# EasyEDA Pro project BlueberryPi.eprj, schematic BlueberryPi Board, sheets 1 to 8 of 13 (continued)
## Sheets (continued)
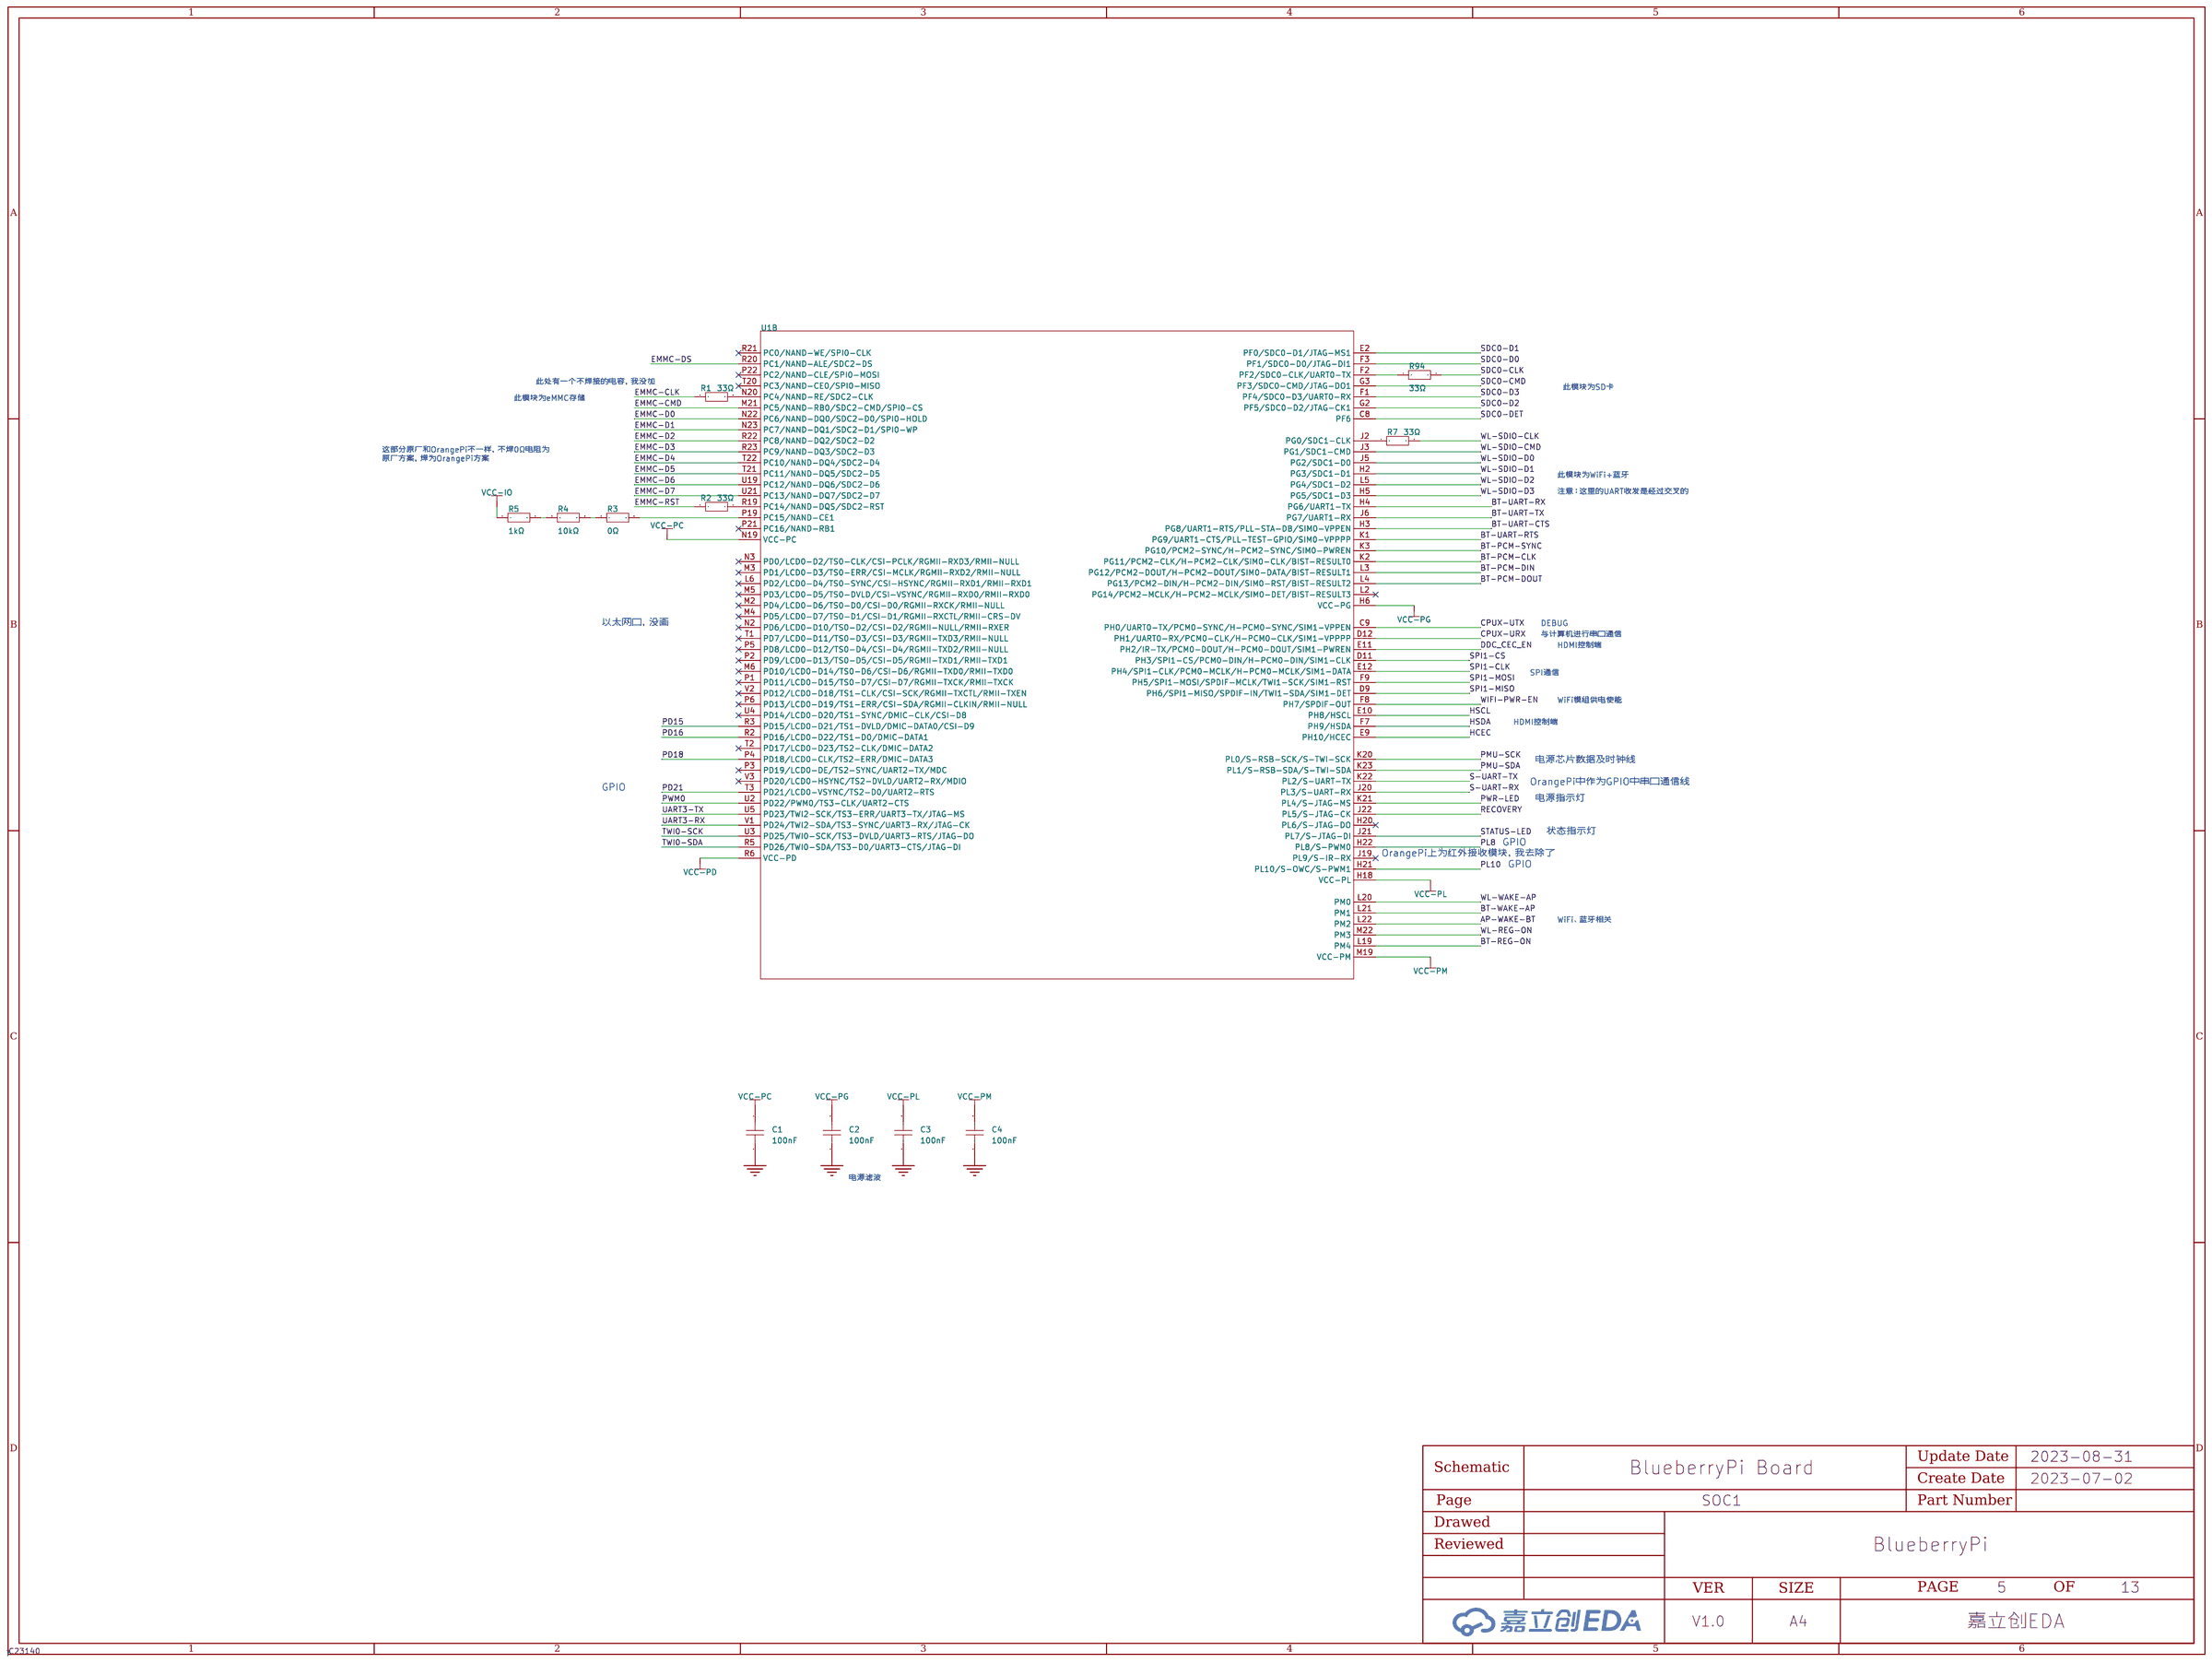
[diagram p4: SOC1]
6 SOC2: Page Name: SOC2; Update Date: 2023-09-08
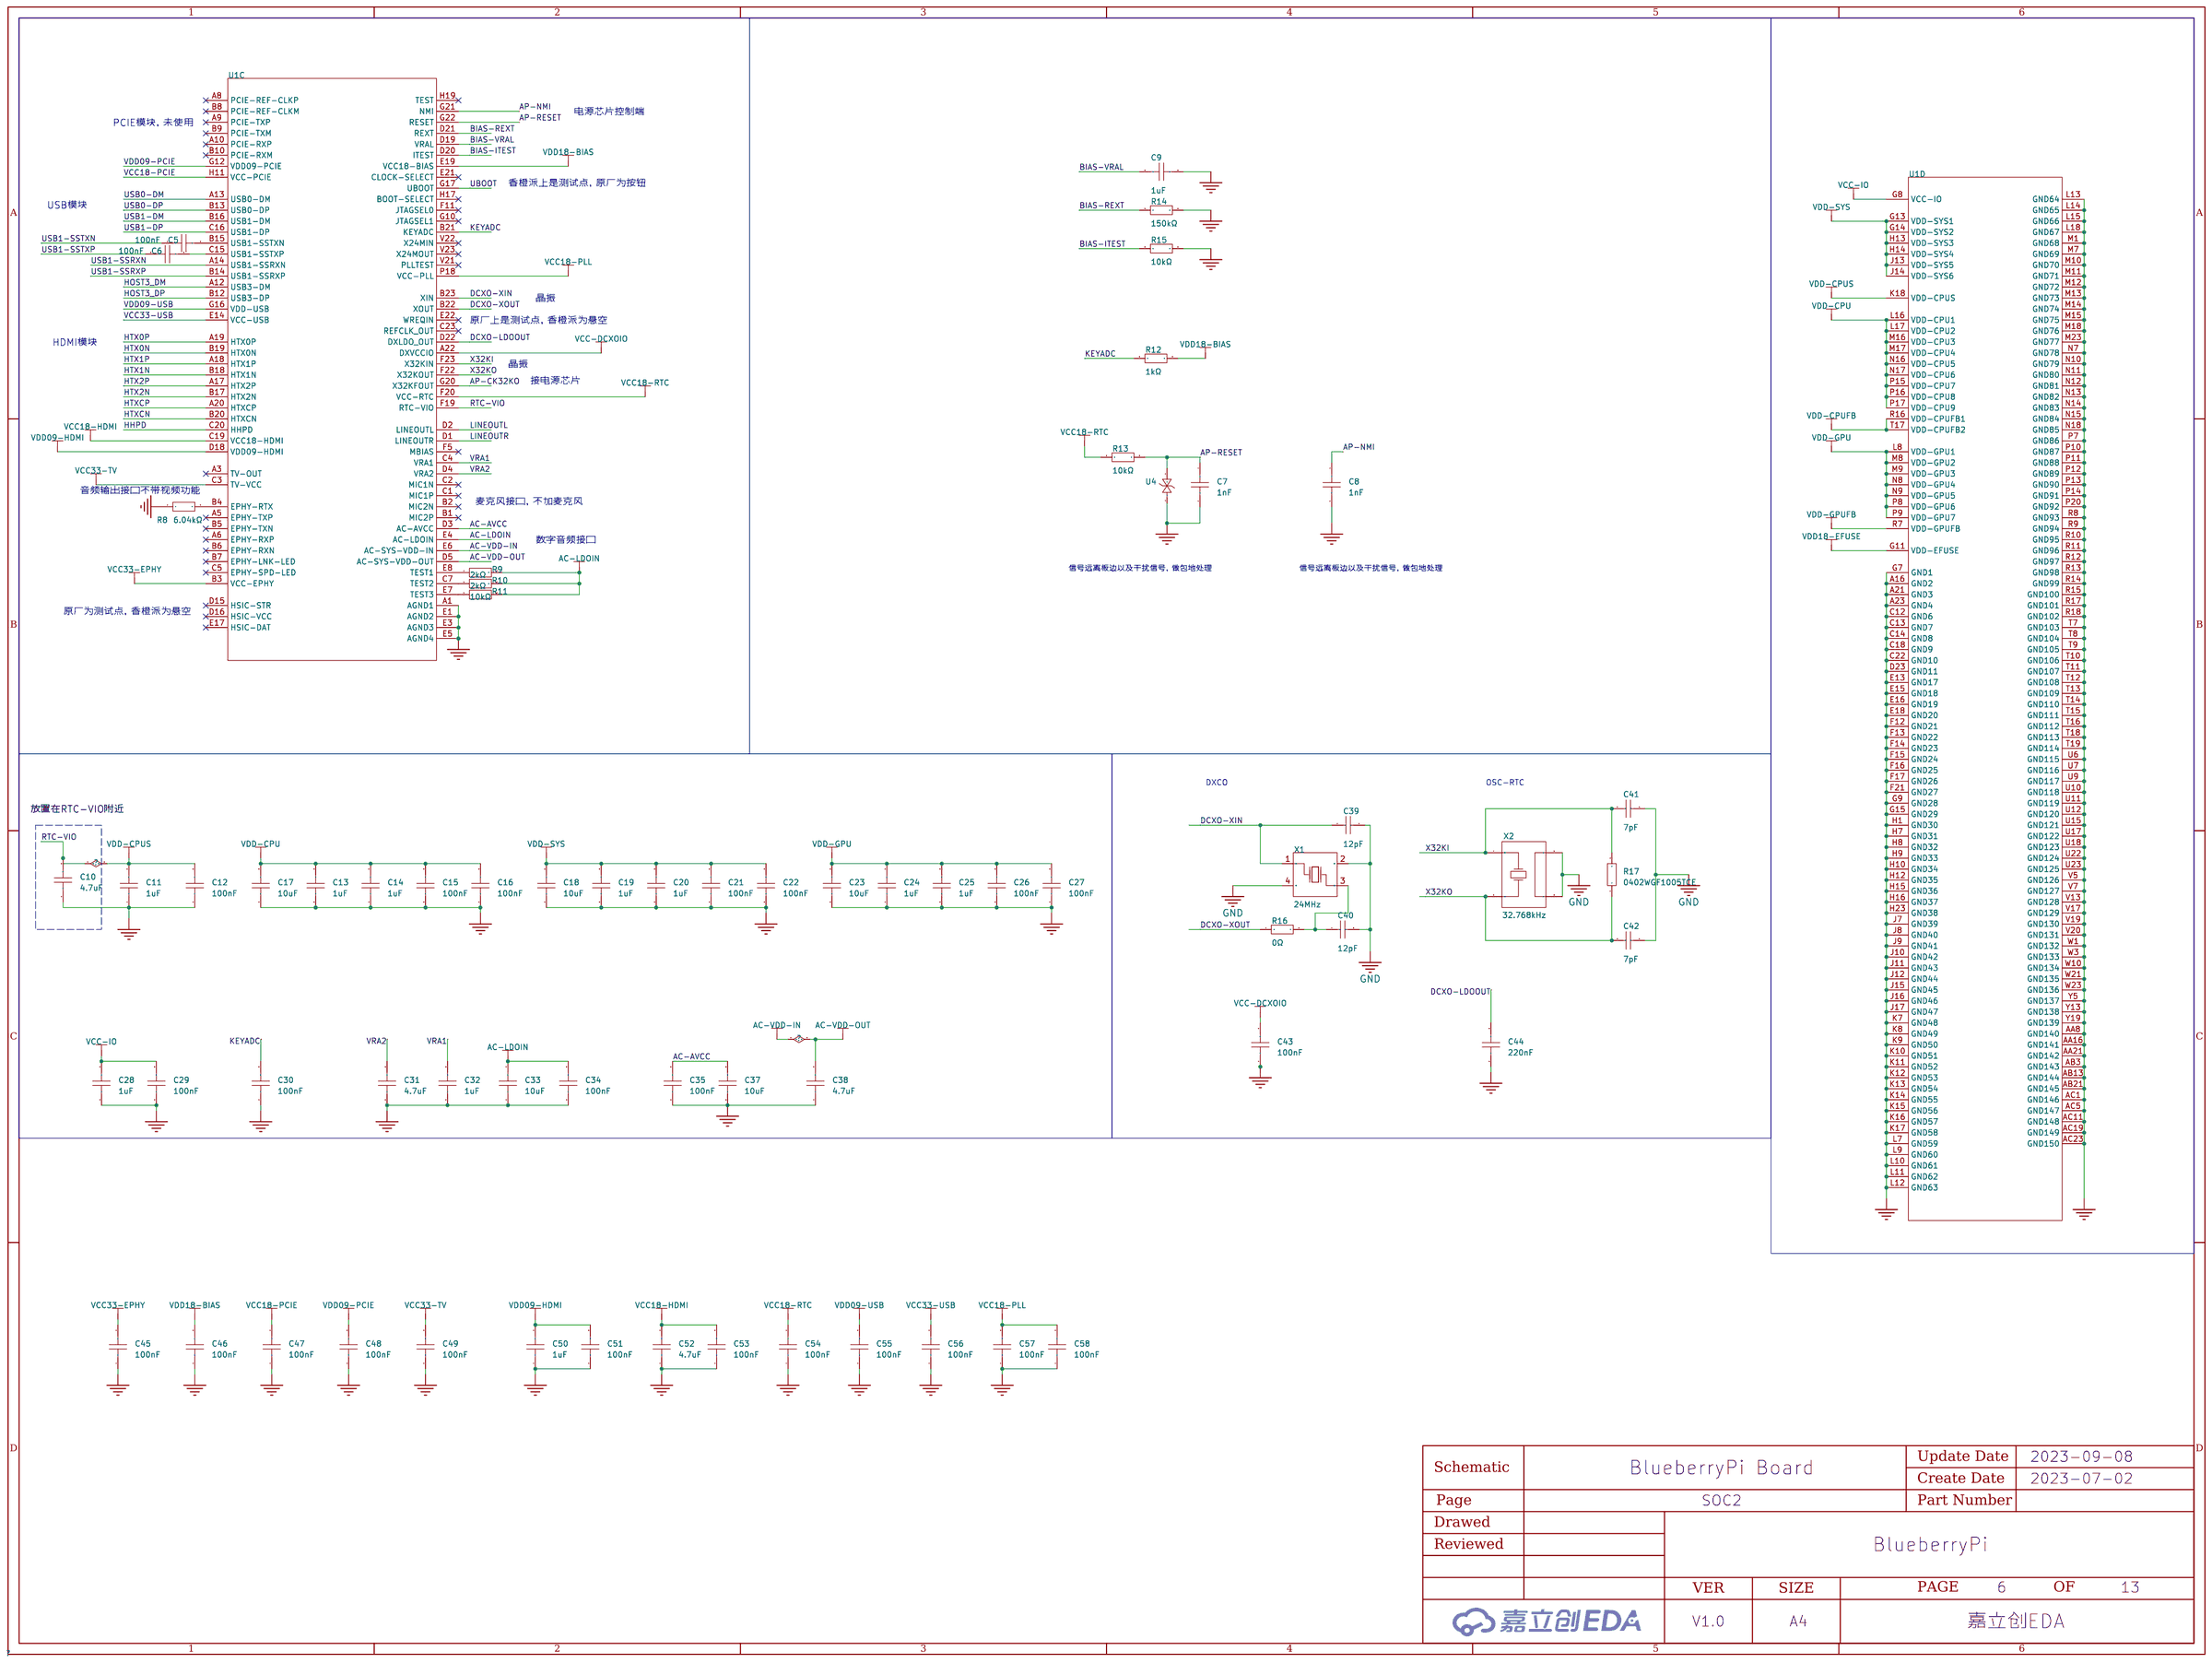
[diagram p5: SOC2]
7 LPDDR3: Page Name: LPDDR3; Update Date: 2023-08-31
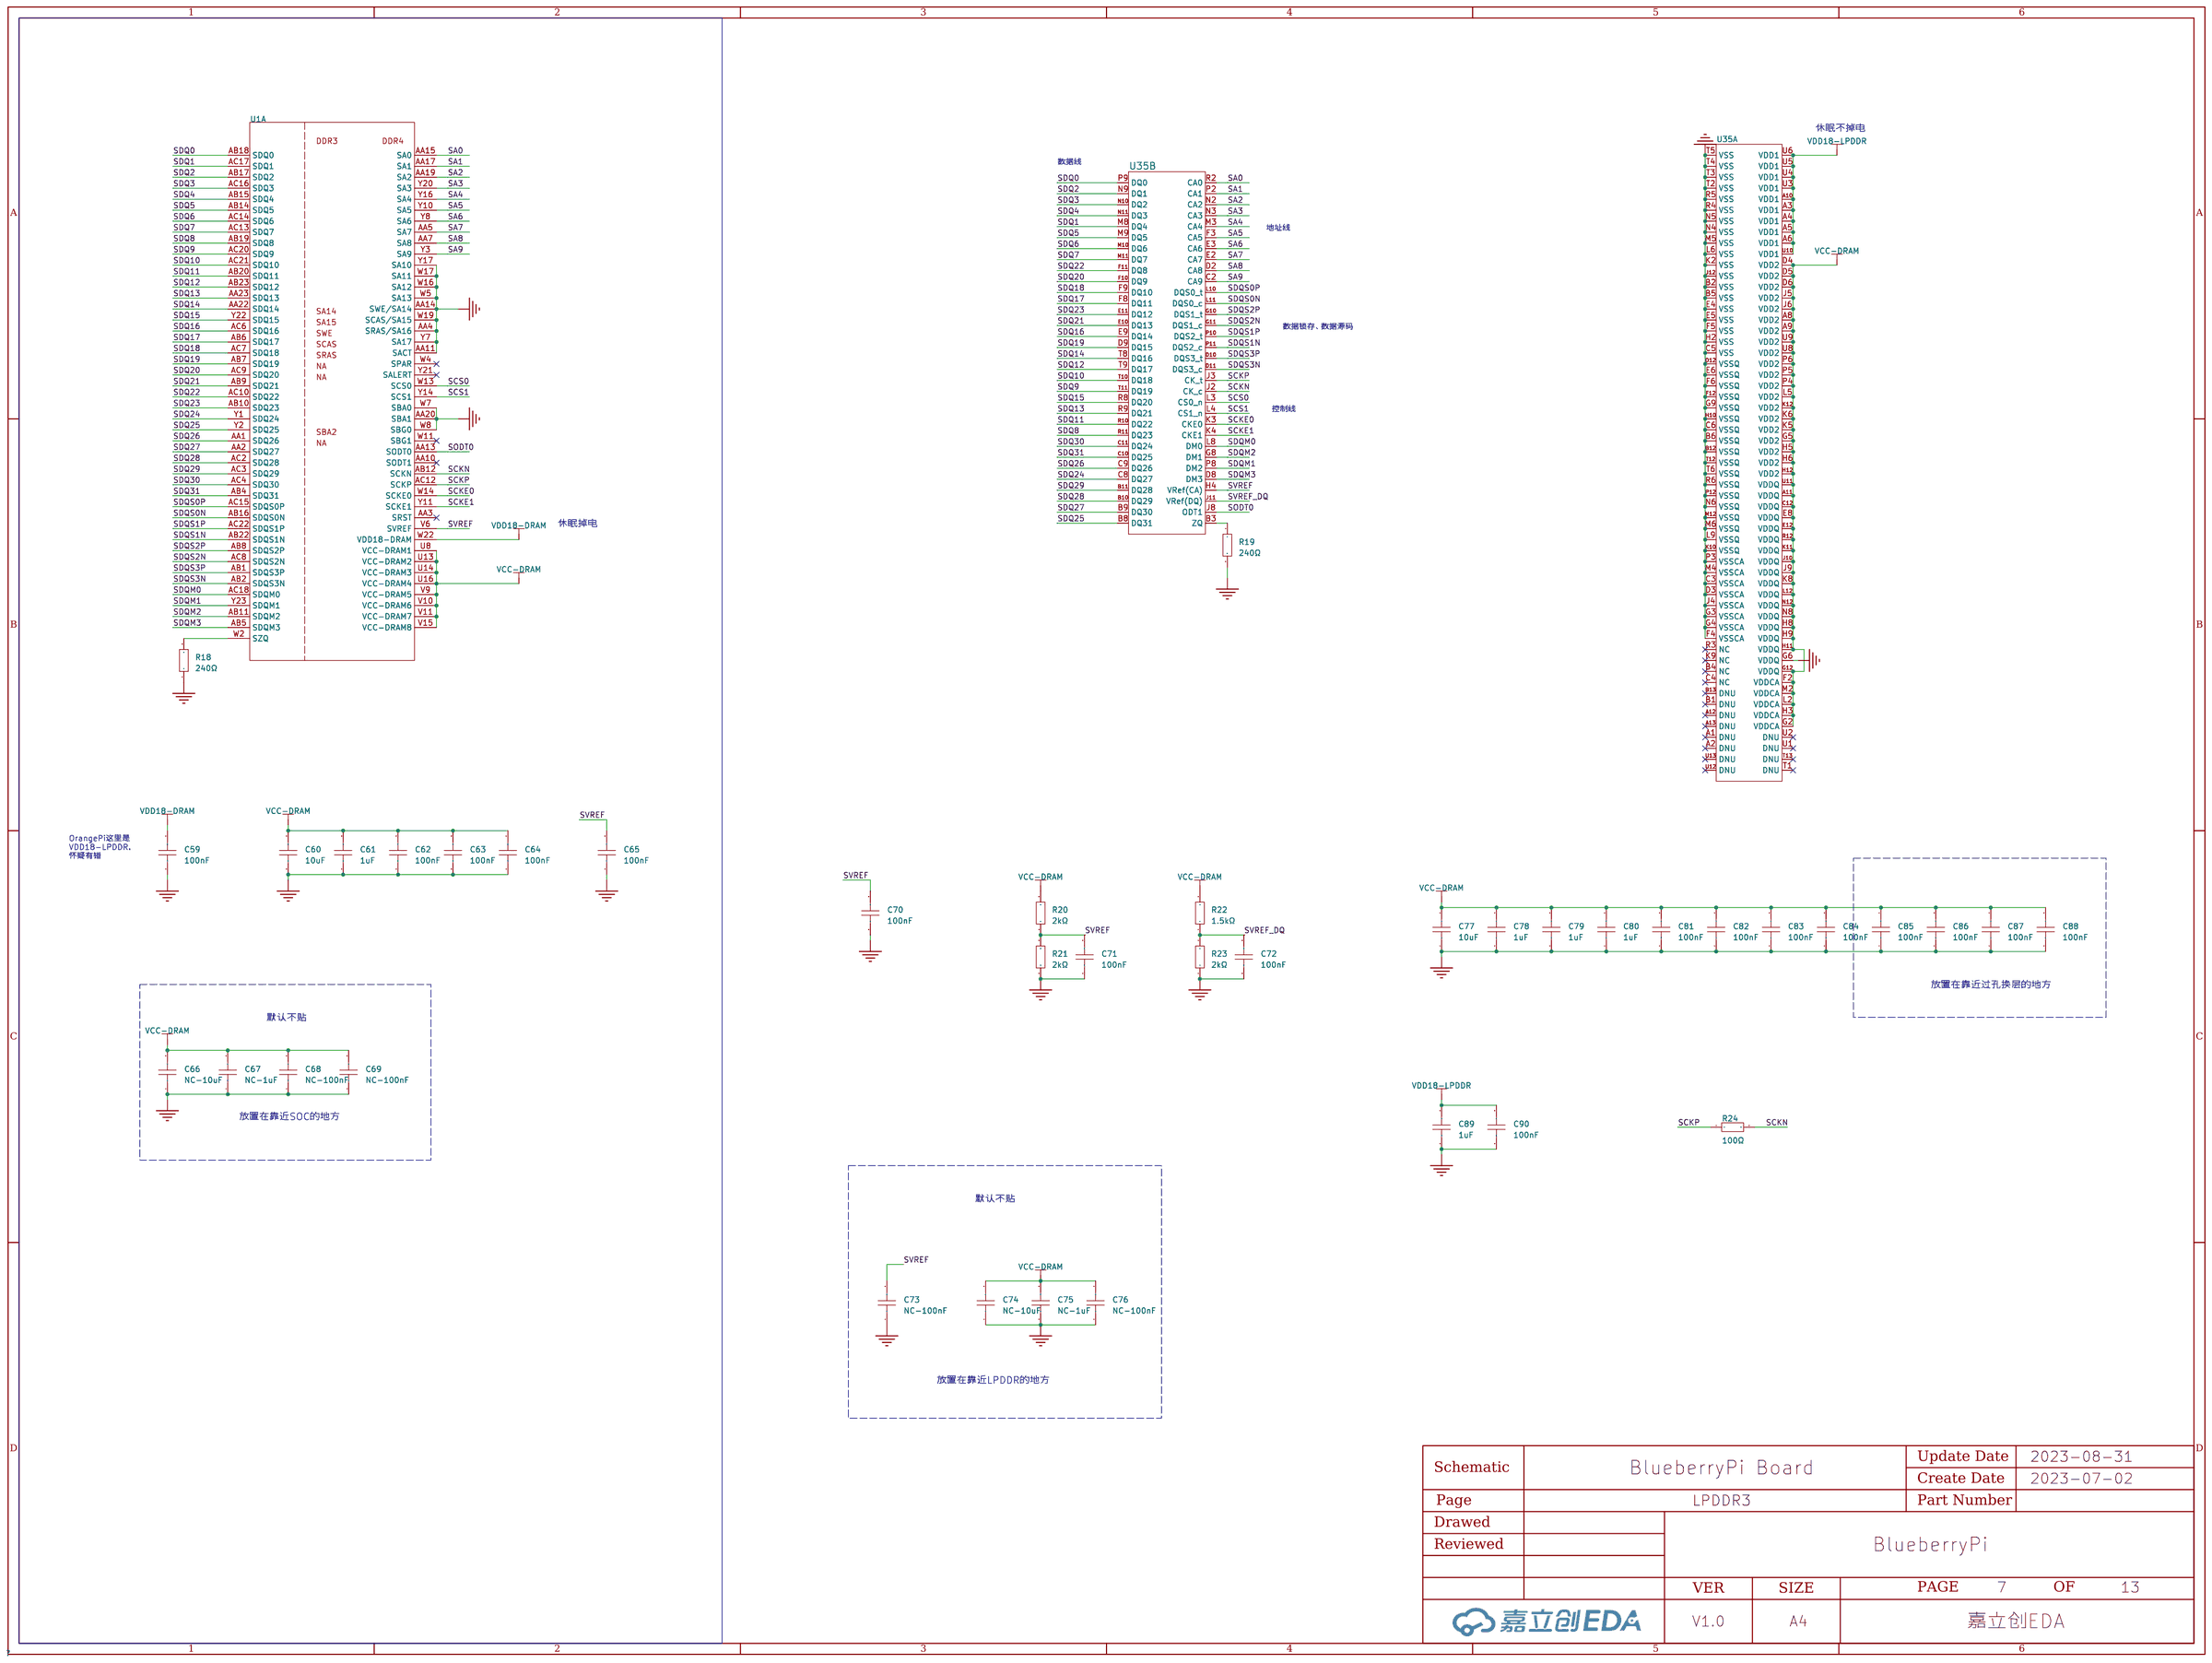
[diagram p6: LPDDR3]
8 POWER: Page Name: POWER; Update Date: 2023-09-08
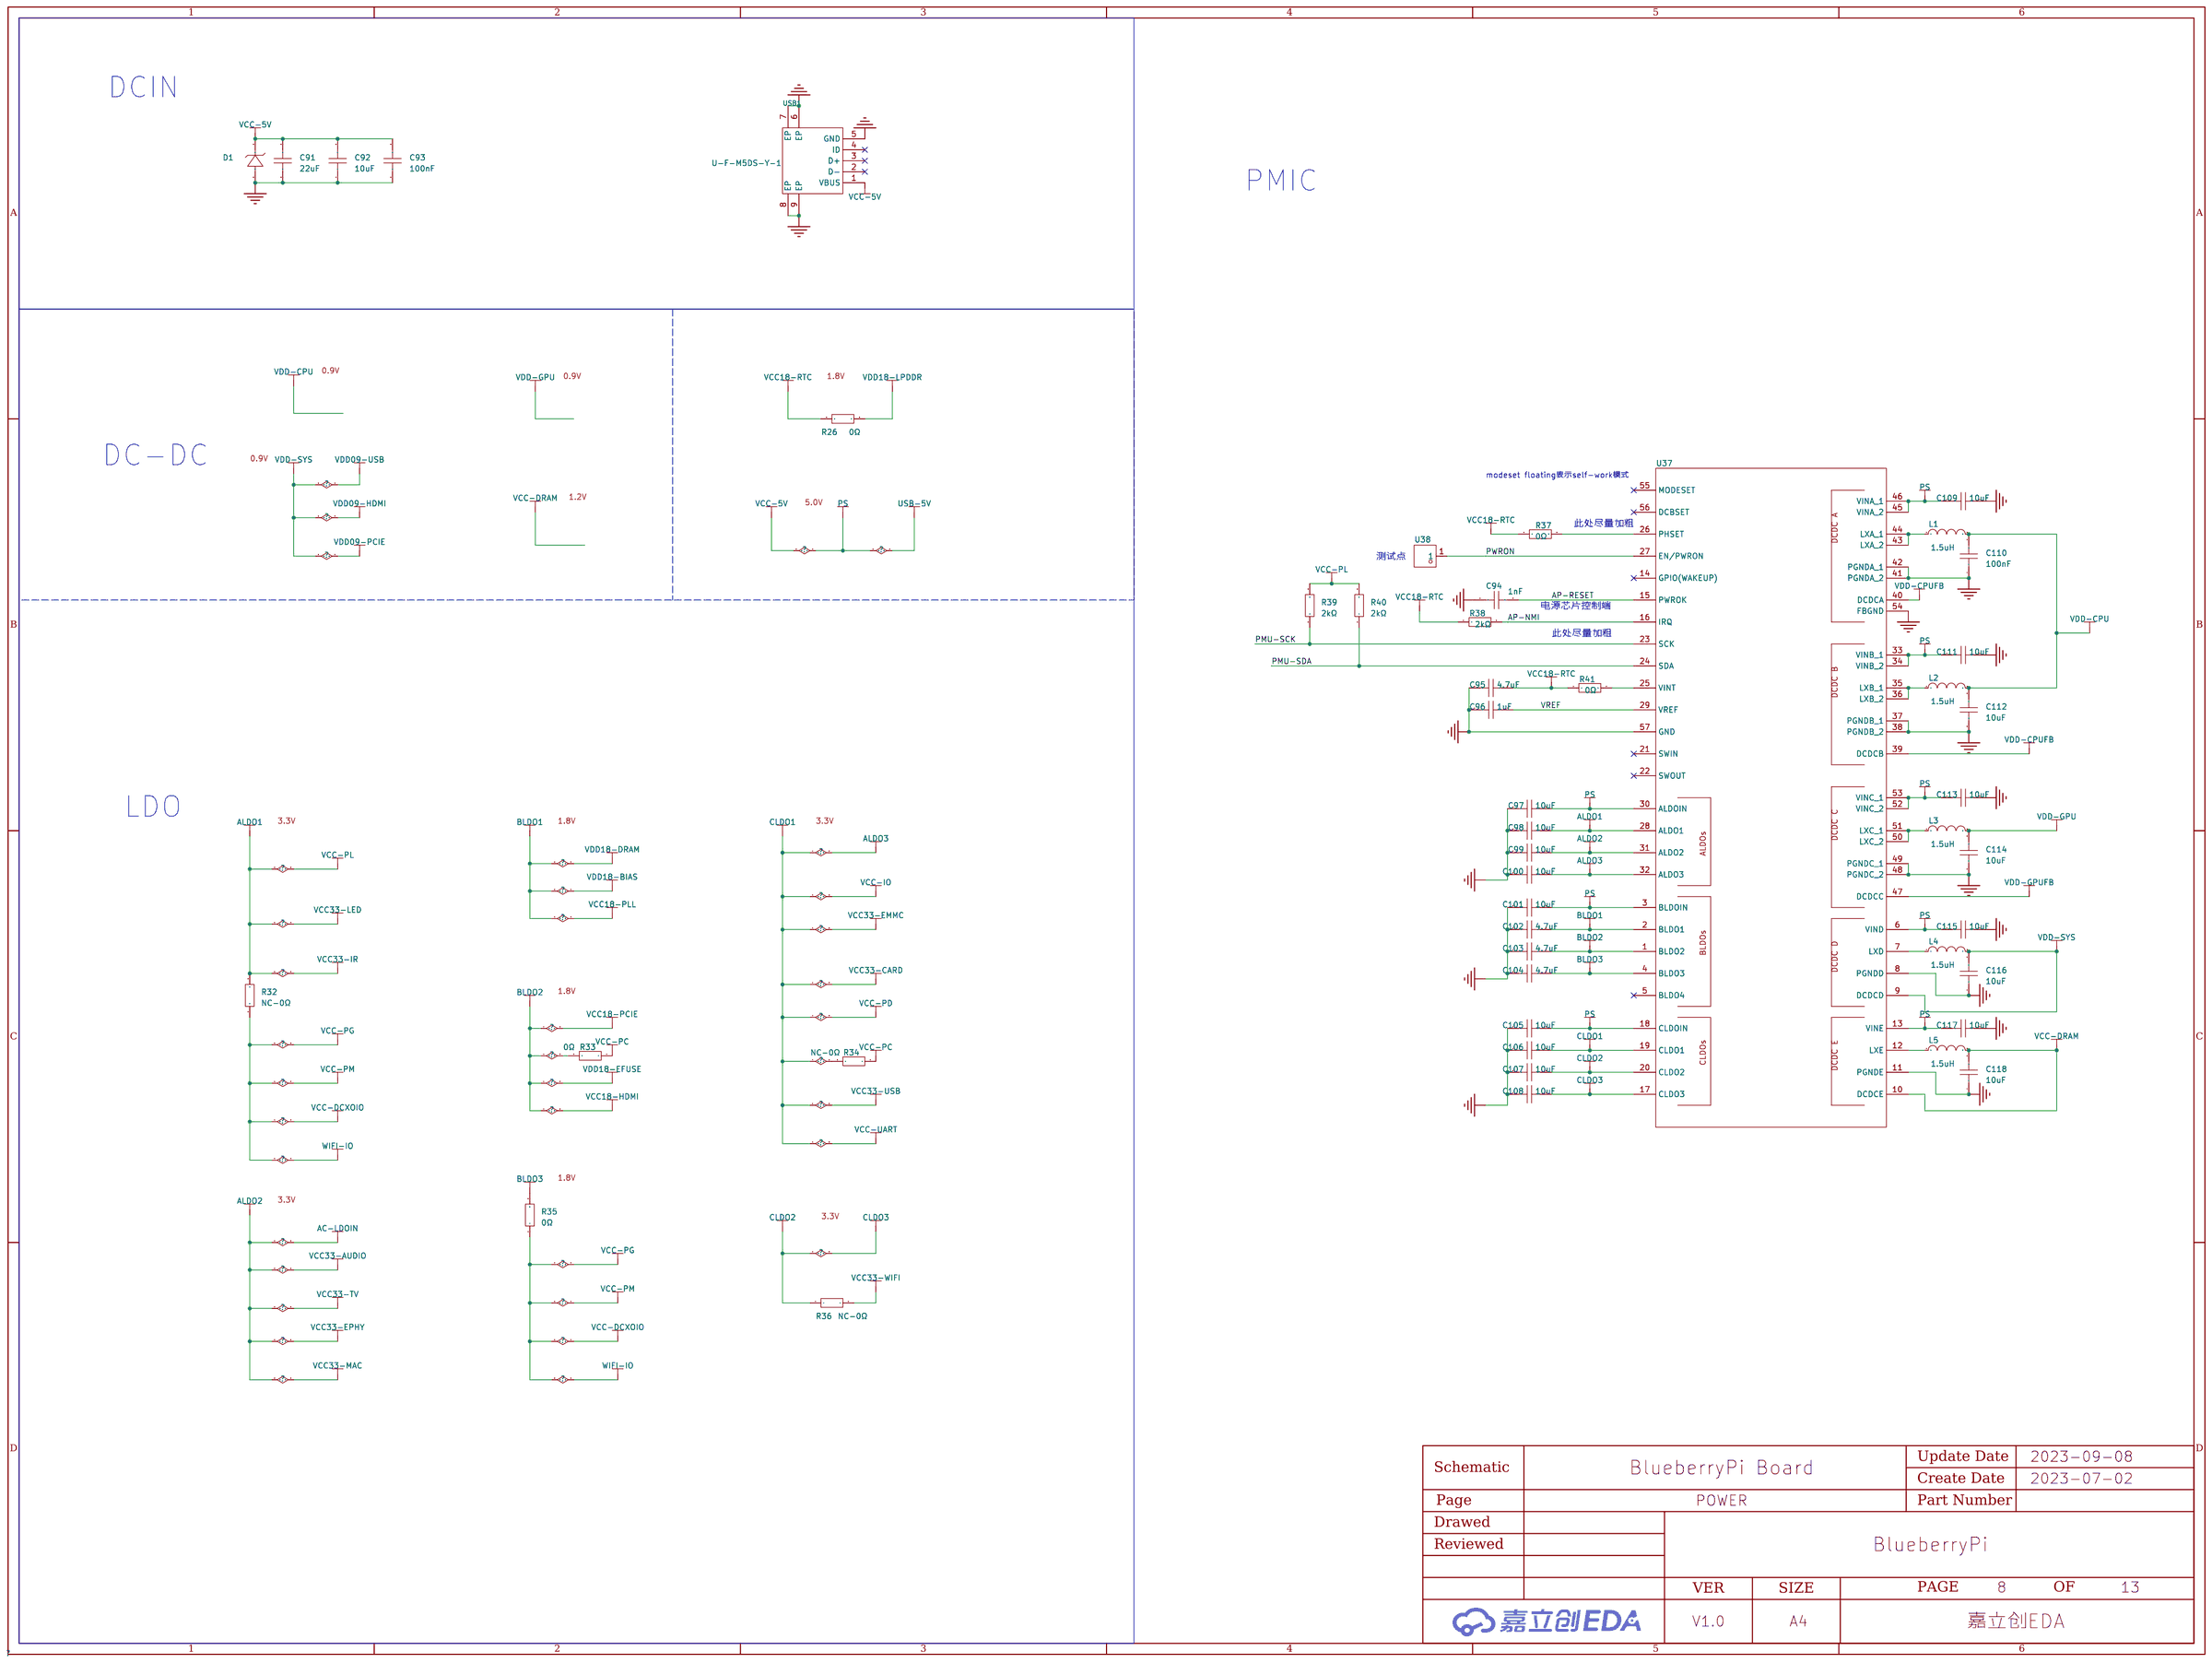
[diagram p7: POWER]

## Parts
sheet LPDDR3
C59  100nF  [C0402]
C60  10uF  [C0603]
C61  1uF  [C0402]
C62  100nF  [C0402]
C63  100nF  [C0402]
C64  100nF  [C0402]
C65  100nF  [C0402]
C66  100nF  [C0603]
C67  100nF  [C0402]
C68  100nF  [C0402]
C69  100nF  [C0402]
C70  100nF  [C0402]
C71  100nF  [C0402]
C72  100nF  [C0402]
C73  100nF  [C0402]
C74  100nF  [C0603]
C75  100nF  [C0402]
C76  100nF  [C0402]
C77  10uF  [C0603]
C78  1uF  [C0402]
C79  1uF  [C0402]
C80  1uF  [C0402]
C81  100nF  [C0402]
C82  100nF  [C0402]
C83  100nF  [C0402]
C84  100nF  [C0402]
C85  100nF  [C0402]
C86  100nF  [C0402]
C87  100nF  [C0402]
C88  100nF  [C0402]
C89  1uF  [C0402]
C90  100nF  [C0402]
R18  240Ω  [R0402]
R19  240Ω  [R0402]
R20  2kΩ  [R0402]
R21  2kΩ  [R0402]
R22  1.5kΩ  [R0402]
R23  2kΩ  [R0402]
R24  100Ω  [R0402]
U35  -  [FBGA-178_L11.5-W11.0_K4E6E304EC-TL]  (sections 1,2)
sheet POWER
C91  22uF  [C0805]
C92  10uF  [C0603]
C93  100nF  [C0402]
C94  1nF  [C0402]
C95  4.7uF  [C0603]
C96  1uF  [C0402]
C97  10uF  [C0603]
C98  10uF  [C0603]
C99  10uF  [C0603]
C100  10uF  [C0603]
C101  10uF  [C0603]
C102  4.7uF  [C0603]
C103  4.7uF  [C0603]
C104  4.7uF  [C0603]
C105  10uF  [C0603]
C106  10uF  [C0603]
C107  10uF  [C0603]
C108  10uF  [C0603]
C109  10uF  [C0603]
C110  100nF  [C0603]
C111  10uF  [C0603]
C112  10uF  [C0603]
C113  10uF  [C0603]
C114  10uF  [C0603]
C115  10uF  [C0603]
C116  10uF  [C0603]
C117  10uF  [C0603]
C118  10uF  [C0603]
D1  SMAJ5.0A  [SMA_L4.3-W2.6-LS5.0-RD]
L1  1.5uH  [IND-SMD_L4.0-W4.0]
L2  1.5uH  [IND-SMD_L4.0-W4.0]
L3  1.5uH  [IND-SMD_L4.0-W4.0]
L4  1.5uH  [IND-SMD_L4.0-W4.0]
L5  1.5uH  [IND-SMD_L4.0-W4.0]
R26  0Ω  [R0603]
R32  NC-0Ω  [R0603]
R33  0Ω  [R0603]
R34  NC-0Ω  [R0603]
R35  0Ω  [R0603]
R36  NC-0Ω  [R0603]
R37  0Ω  [R0402]
R38  2kΩ  [R0402]
R39  2kΩ  [R0402]
R40  2kΩ  [R0402]
R41  0Ω  [R0402]
U37  -  [QFN-56_L7.0-W7.0-P0.40-TL-EP4.6]
U38  TP-红色测试点  [TESTPOINT-TH_BD3.2]
USB1  U-F-M5DS-Y-1  [MICRO-USB-SMD_U-F-M5DS-Y-1]
sheet SOC1
C1  100nF  [C0402]
C2  100nF  [C0402]
C3  100nF  [C0402]
C4  100nF  [C0402]
R1  33Ω  [R0603]
R2  33Ω  [R0603]
R3  0Ω  [R0402]
R4  10kΩ  [R0402]
R5  1kΩ  [R0402]
R7  33Ω  [R0402]
R94  33Ω  [R0603]
U1  -  [BGA451_ALLWINNER_H6]  (sections 1,2,3,4)
sheet SOC2
C5  100nF  [C0402]
C6  100nF  [C0402]
C7  1nF  [C0402]
C8  1nF  [C0402]
C9  1uF  [C0402]
C10  4.7uF  [C0603]
C11  1uF  [C0402]
C12  100nF  [C0402]
C13  1uF  [C0402]
C14  1uF  [C0402]
C15  100nF  [C0402]
C16  100nF  [C0402]
C17  10uF  [C0603]
C18  10uF  [C0603]
C19  1uF  [C0402]
C20  1uF  [C0402]
C21  100nF  [C0402]
C22  100nF  [C0402]
C23  10uF  [C0603]
C24  1uF  [C0402]
C25  1uF  [C0402]
C26  100nF  [C0402]
C27  100nF  [C0402]
C28  1uF  [C0402]
C29  100nF  [C0402]
C30  100nF  [C0402]
C31  4.7uF  [C0603]
C32  1uF  [C0402]
C33  10uF  [C0603]
C34  100nF  [C0402]
C35  100nF  [C0402]
C37  10uF  [C0603]
C38  4.7uF  [C0603]
C39  12pF  [C0603]
C40  12pF  [C0603]
C41  7pF  [C0603]
C42  7pF  [C0603]
C43  100nF  [C0402]
C44  220nF  [C0402]
C45  100nF  [C0402]
C46  100nF  [C0402]
C47  100nF  [C0402]
C48  100nF  [C0402]
C49  100nF  [C0402]
C50  1uF  [C0402]
C51  100nF  [C0402]
C52  4.7uF  [C0402]
C53  100nF  [C0402]
C54  100nF  [C0402]
C55  100nF  [C0402]
C56  100nF  [C0402]
C57  100nF  [C0402]
C58  100nF  [C0402]
R8  6.04kΩ  [R0402]
R9  2kΩ  [R0402]
R10  2kΩ  [R0402]
R11  10kΩ  [R0402]
R12  1kΩ  [R0402]
R13  10kΩ  [R0402]
R14  150kΩ  [R0402]
R15  10kΩ  [R0402]
R16  0Ω  [R0402]
R17  10K  [R0402]
U4  -  [DFN1006-2L_L1.0-W0.6-P0.70-BI]
X1  24MHz  [CRYSTAL-SMD_4P-L3.2-W2.5-BL]
X2  32.768kHz  [MC-146_4P-L6.7-W1.5-P0.85-TL]
